# Altium schematic sheet transmitter.SchDoc
size A1
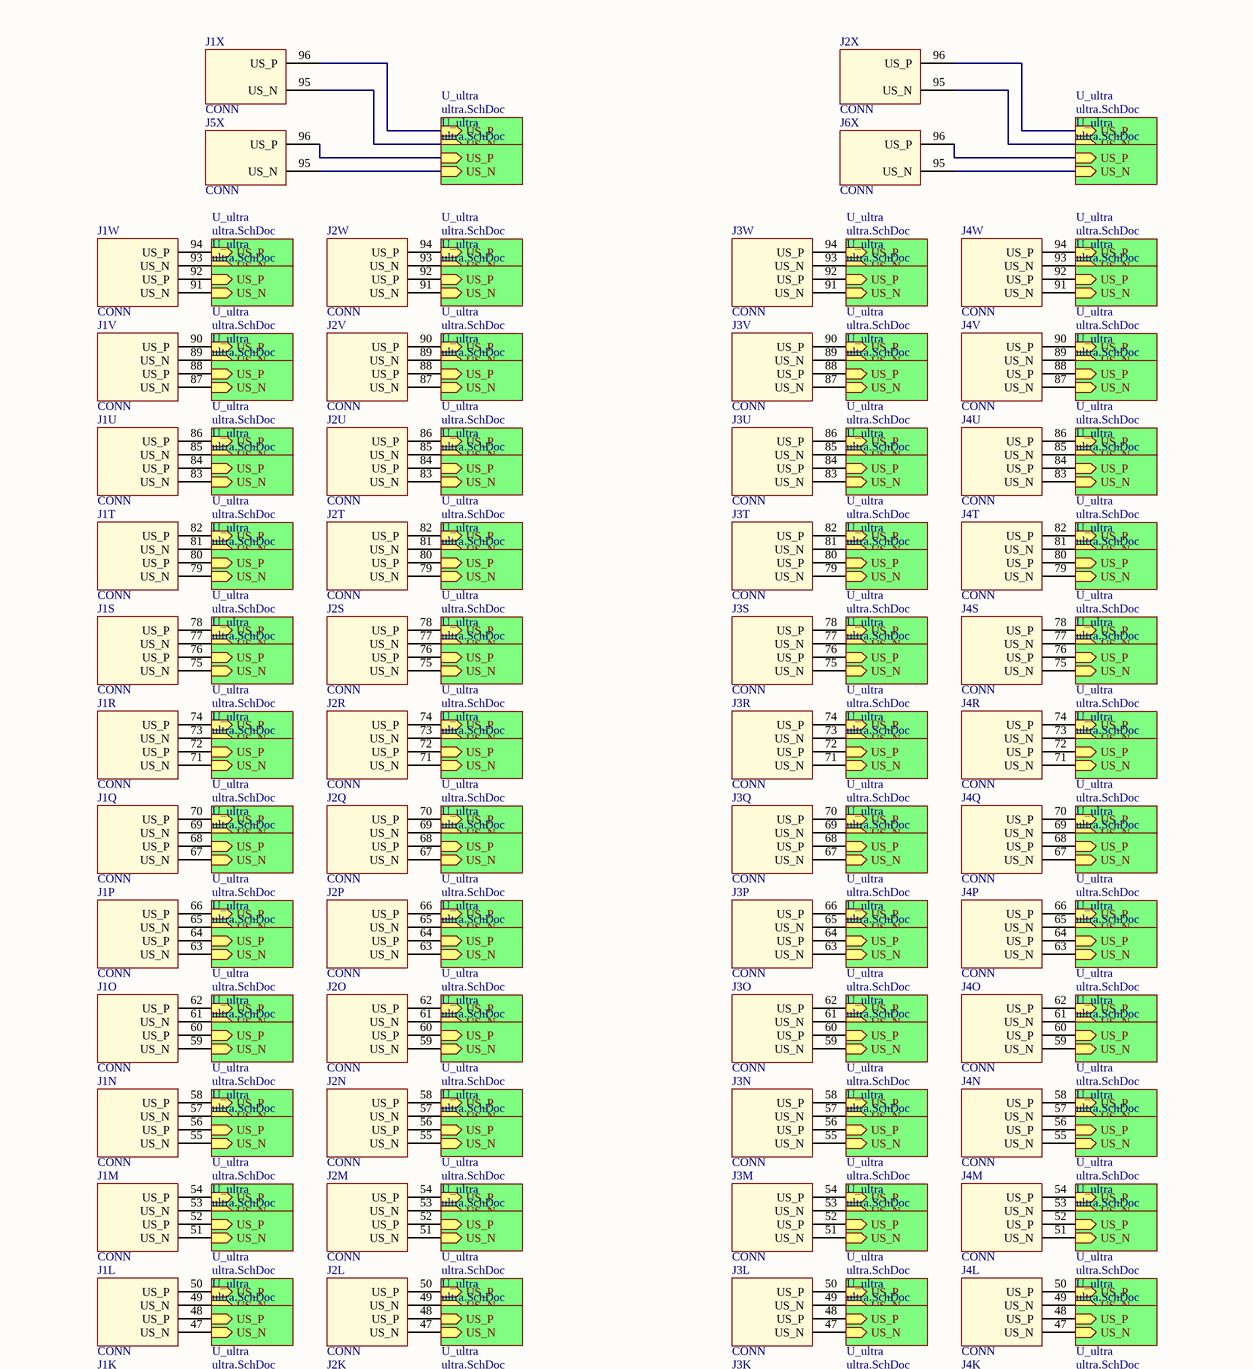
[diagram p0: transmitter.SchDoc, top left]
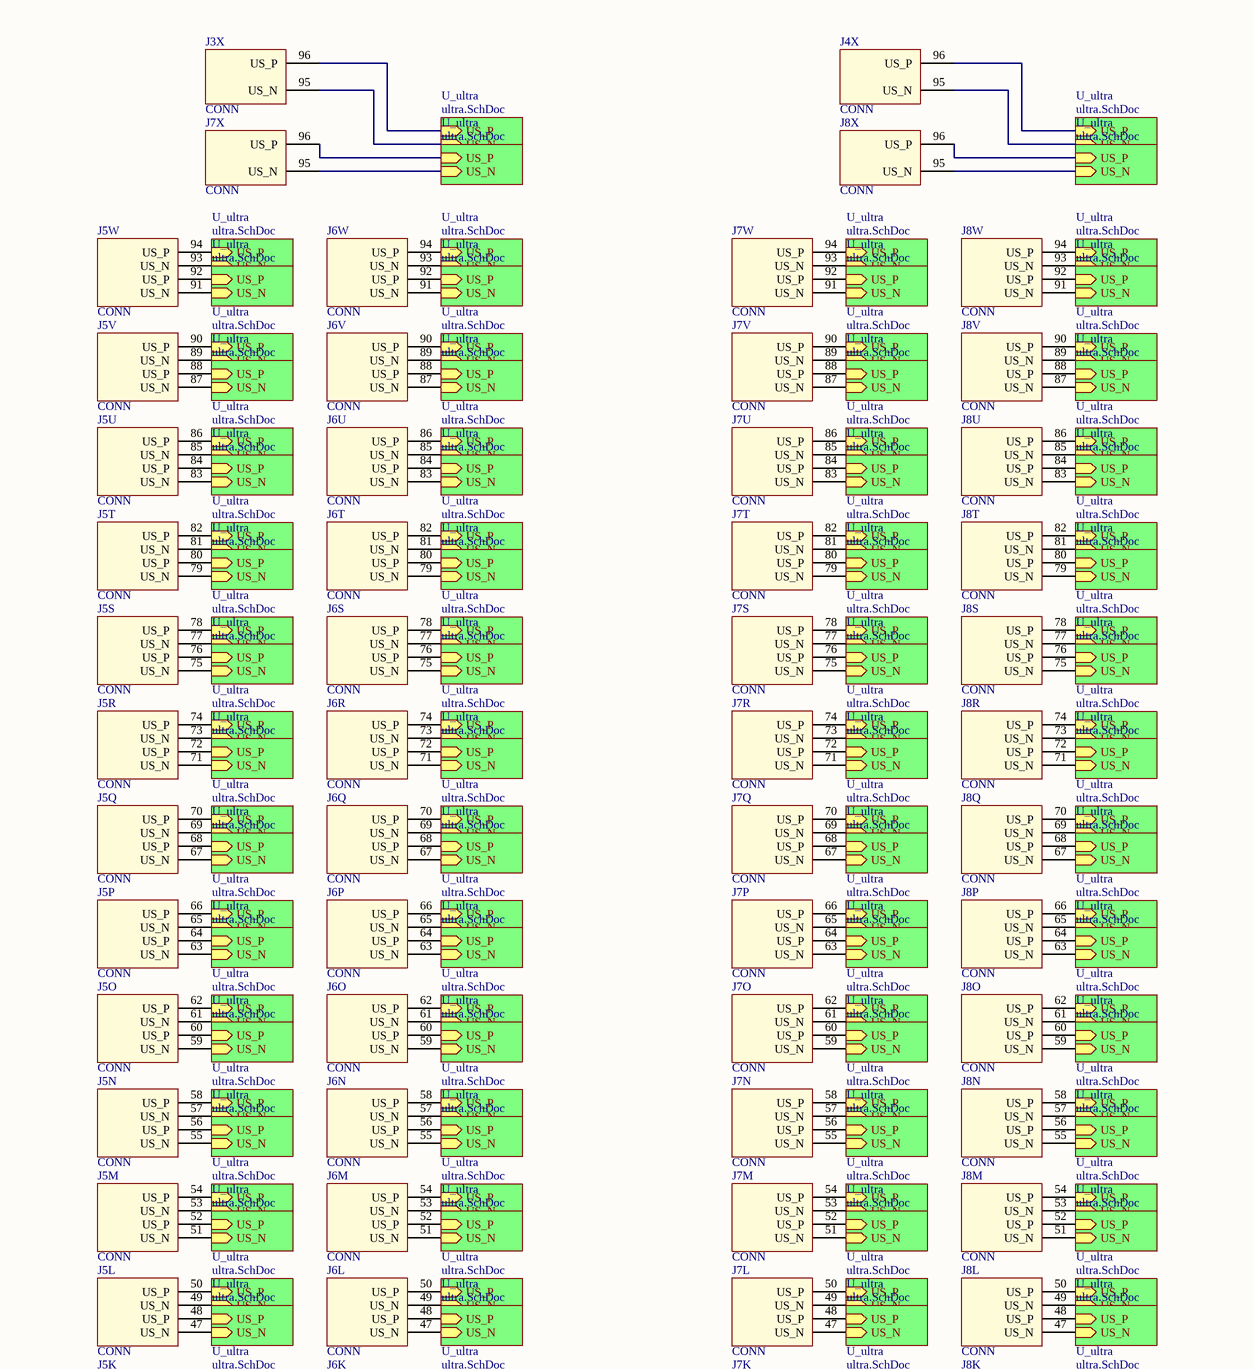
[diagram p1: transmitter.SchDoc, top right]
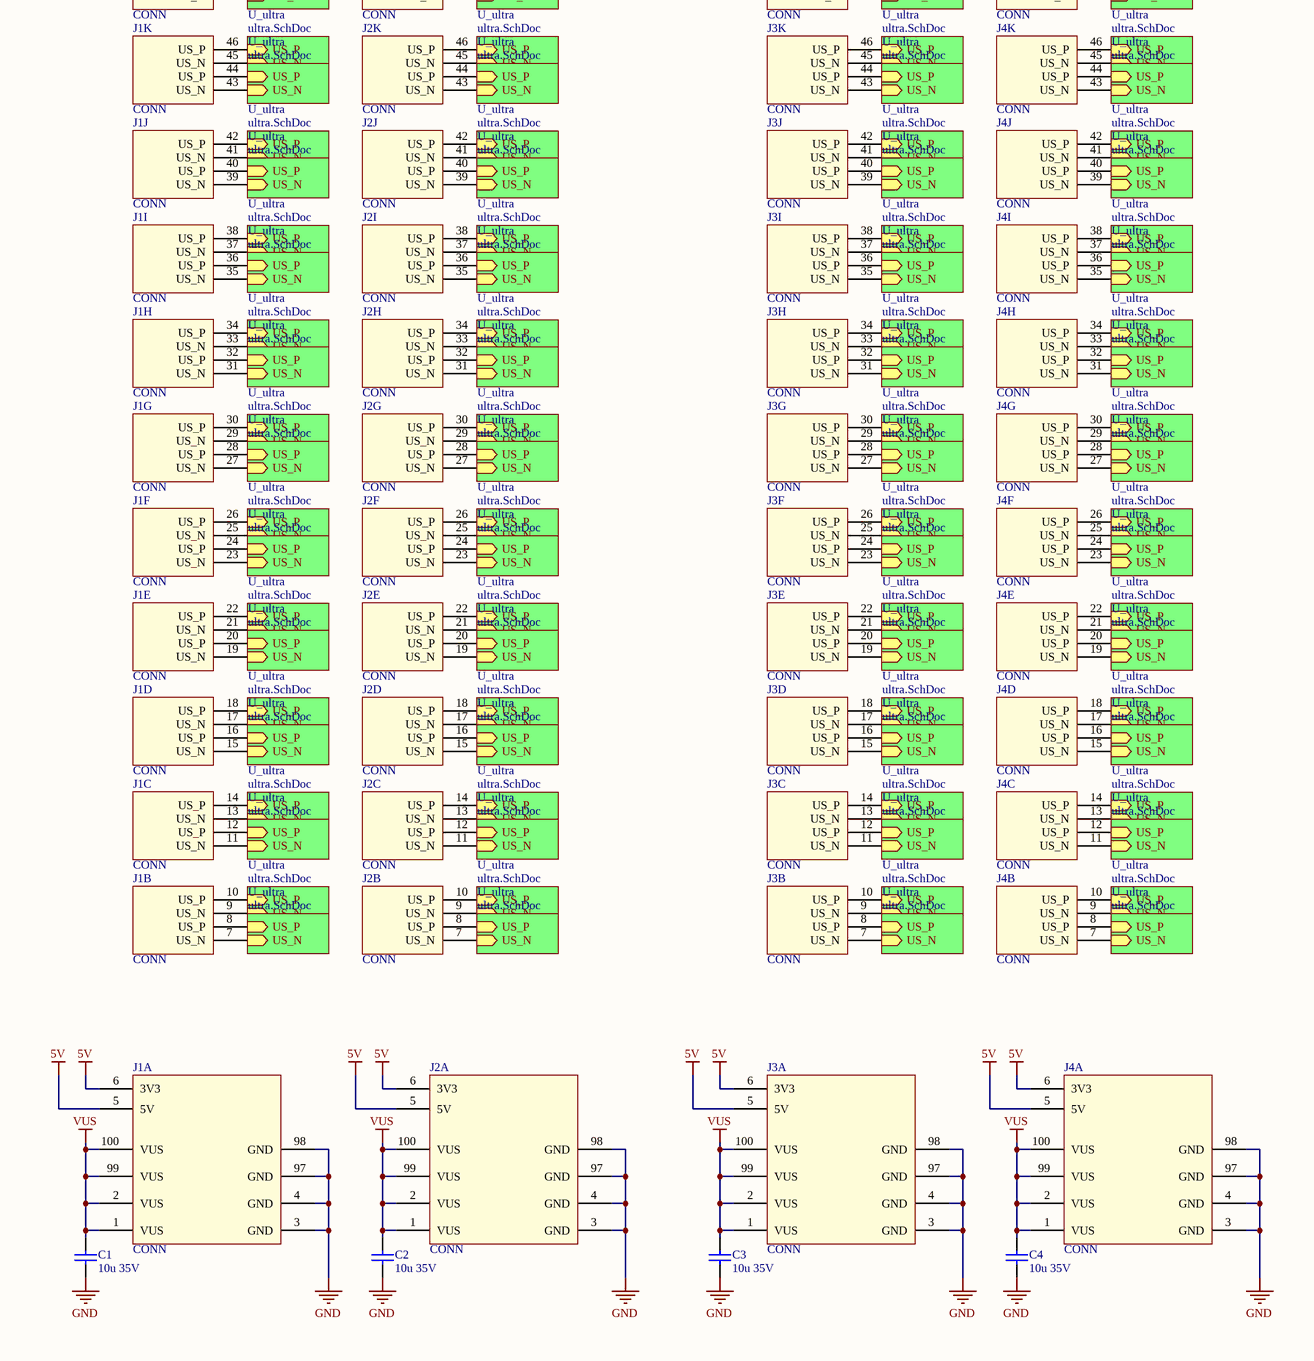
[diagram p2: transmitter.SchDoc, bottom left]
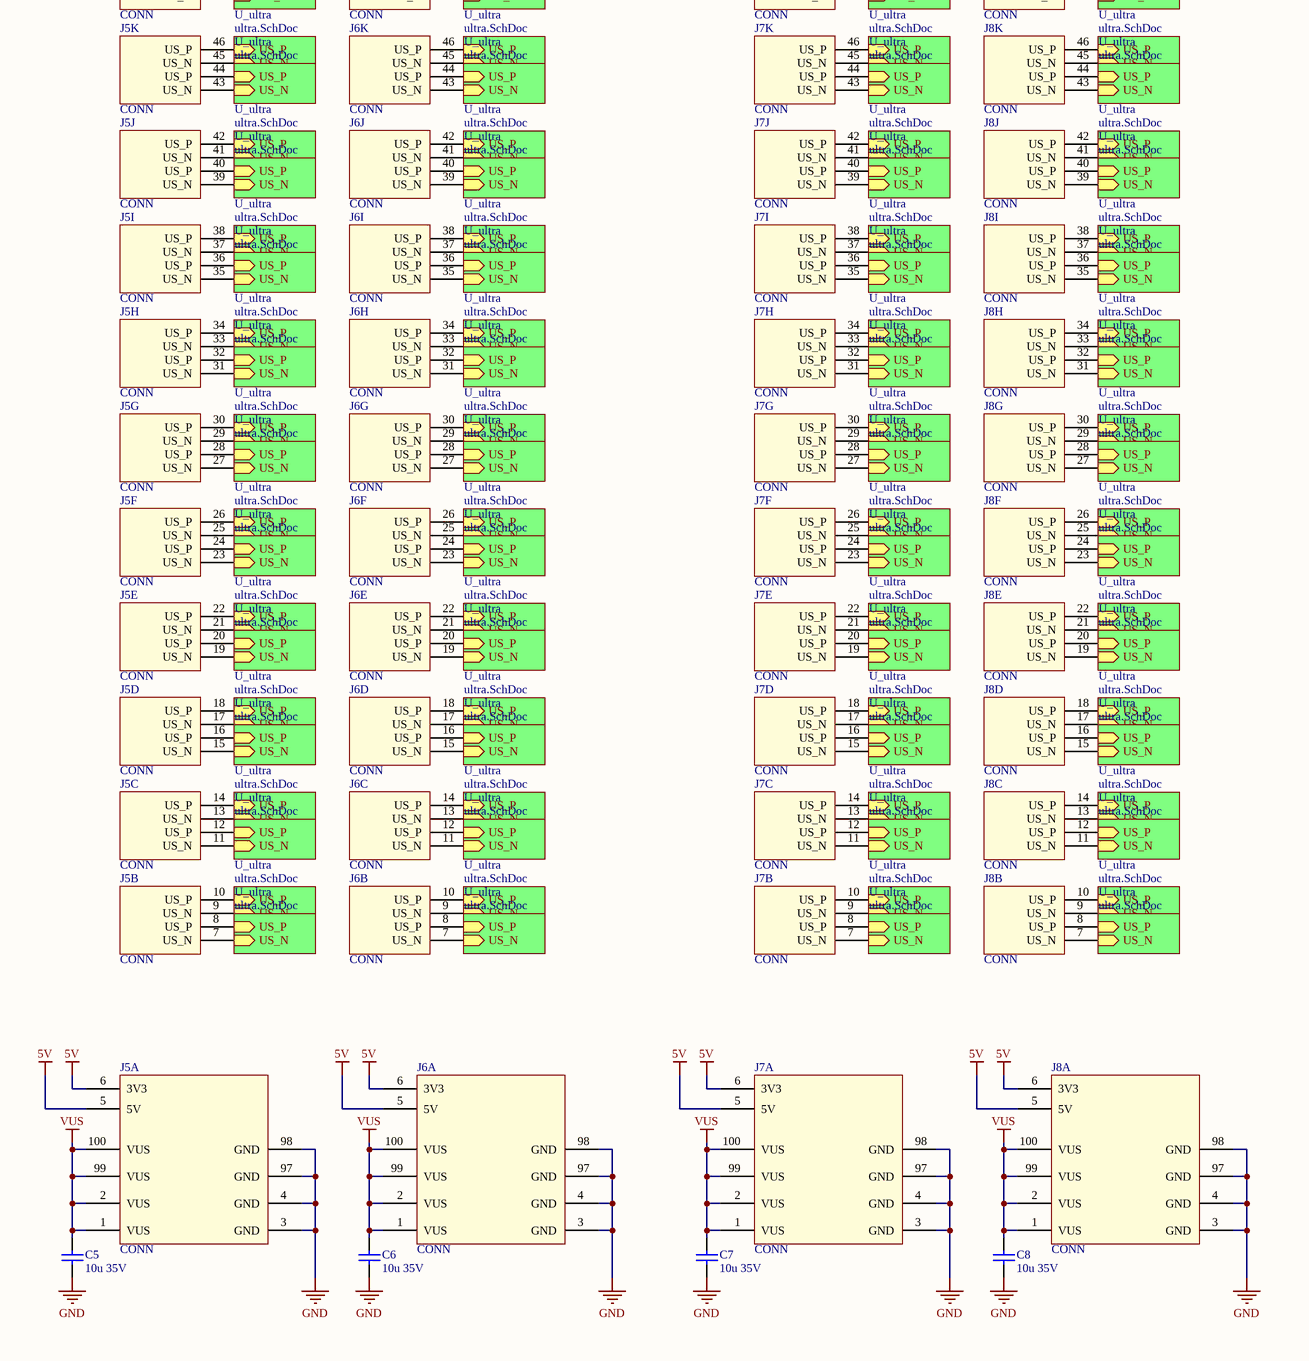
[diagram p3: transmitter.SchDoc, bottom right]

## Parts
C1  10u 35V  [C-0805-M]
C2  10u 35V  [C-0805-M]
C3  10u 35V  [C-0805-M]
C4  10u 35V  [C-0805-M]
C5  10u 35V  [C-0805-M]
C6  10u 35V  [C-0805-M]
C7  10u 35V  [C-0805-M]
C8  10u 35V  [C-0805-M]
J1  CONN  [SOP127P640X300-100L]  (parts A,B,C,D,E,F,G,H,I,J,K,L,M,N,O,P,Q,R,S,T,U,V,W,X of 24)
J2  CONN  [SOP127P640X300-100L]  (parts A,B,C,D,E,F,G,H,I,J,K,L,M,N,O,P,Q,R,S,T,U,V,W,X of 24)
J3  CONN  [SOP127P640X300-100L]  (parts A,B,C,D,E,F,G,H,I,J,K,L,M,N,O,P,Q,R,S,T,U,V,W,X of 24)
J4  CONN  [SOP127P640X300-100L]  (parts A,B,C,D,E,F,G,H,I,J,K,L,M,N,O,P,Q,R,S,T,U,V,W,X of 24)
J5  CONN  [SOP127P640X300-100L]  (parts A,B,C,D,E,F,G,H,I,J,K,L,M,N,O,P,Q,R,S,T,U,V,W,X of 24)
J6  CONN  [SOP127P640X300-100L]  (parts A,B,C,D,E,F,G,H,I,J,K,L,M,N,O,P,Q,R,S,T,U,V,W,X of 24)
J7  CONN  [SOP127P640X300-100L]  (parts A,B,C,D,E,F,G,H,I,J,K,L,M,N,O,P,Q,R,S,T,U,V,W,X of 24)
J8  CONN  [SOP127P640X300-100L]  (parts A,B,C,D,E,F,G,H,I,J,K,L,M,N,O,P,Q,R,S,T,U,V,W,X of 24)

## Sub-sheets
U_ultra = ultra.SchDoc: US_P (in), US_N (in)
U_ultra = ultra.SchDoc: US_P (in), US_N (in)
U_ultra = ultra.SchDoc: US_P (in), US_N (in)
U_ultra = ultra.SchDoc: US_P (in), US_N (in)
U_ultra = ultra.SchDoc: US_P (in), US_N (in)
U_ultra = ultra.SchDoc: US_P (in), US_N (in)
U_ultra = ultra.SchDoc: US_P (in), US_N (in)
U_ultra = ultra.SchDoc: US_P (in), US_N (in)
U_ultra = ultra.SchDoc: US_P (in), US_N (in)
U_ultra = ultra.SchDoc: US_P (in), US_N (in)
U_ultra = ultra.SchDoc: US_P (in), US_N (in)
U_ultra = ultra.SchDoc: US_P (in), US_N (in)
U_ultra = ultra.SchDoc: US_P (in), US_N (in)
U_ultra = ultra.SchDoc: US_P (in), US_N (in)
U_ultra = ultra.SchDoc: US_P (in), US_N (in)
U_ultra = ultra.SchDoc: US_P (in), US_N (in)
U_ultra = ultra.SchDoc: US_P (in), US_N (in)
U_ultra = ultra.SchDoc: US_P (in), US_N (in)
U_ultra = ultra.SchDoc: US_P (in), US_N (in)
U_ultra = ultra.SchDoc: US_P (in), US_N (in)
U_ultra = ultra.SchDoc: US_P (in), US_N (in)
U_ultra = ultra.SchDoc: US_P (in), US_N (in)
U_ultra = ultra.SchDoc: US_P (in), US_N (in)
U_ultra = ultra.SchDoc: US_P (in), US_N (in)
U_ultra = ultra.SchDoc: US_P (in), US_N (in)
U_ultra = ultra.SchDoc: US_P (in), US_N (in)
U_ultra = ultra.SchDoc: US_P (in), US_N (in)
U_ultra = ultra.SchDoc: US_P (in), US_N (in)
U_ultra = ultra.SchDoc: US_P (in), US_N (in)
U_ultra = ultra.SchDoc: US_P (in), US_N (in)
U_ultra = ultra.SchDoc: US_P (in), US_N (in)
U_ultra = ultra.SchDoc: US_P (in), US_N (in)
U_ultra = ultra.SchDoc: US_P (in), US_N (in)
U_ultra = ultra.SchDoc: US_P (in), US_N (in)
U_ultra = ultra.SchDoc: US_P (in), US_N (in)
U_ultra = ultra.SchDoc: US_P (in), US_N (in)
U_ultra = ultra.SchDoc: US_P (in), US_N (in)
U_ultra = ultra.SchDoc: US_P (in), US_N (in)
U_ultra = ultra.SchDoc: US_P (in), US_N (in)
U_ultra = ultra.SchDoc: US_P (in), US_N (in)
U_ultra = ultra.SchDoc: US_P (in), US_N (in)
U_ultra = ultra.SchDoc: US_P (in), US_N (in)
U_ultra = ultra.SchDoc: US_P (in), US_N (in)
U_ultra = ultra.SchDoc: US_P (in), US_N (in)
U_ultra = ultra.SchDoc: US_P (in), US_N (in)
U_ultra = ultra.SchDoc: US_P (in), US_N (in)
U_ultra = ultra.SchDoc: US_P (in), US_N (in)
U_ultra = ultra.SchDoc: US_P (in), US_N (in)
U_ultra = ultra.SchDoc: US_P (in), US_N (in)
U_ultra = ultra.SchDoc: US_P (in), US_N (in)
U_ultra = ultra.SchDoc: US_P (in), US_N (in)
U_ultra = ultra.SchDoc: US_P (in), US_N (in)
U_ultra = ultra.SchDoc: US_P (in), US_N (in)
U_ultra = ultra.SchDoc: US_P (in), US_N (in)
U_ultra = ultra.SchDoc: US_P (in), US_N (in)
U_ultra = ultra.SchDoc: US_P (in), US_N (in)
U_ultra = ultra.SchDoc: US_P (in), US_N (in)
U_ultra = ultra.SchDoc: US_P (in), US_N (in)
U_ultra = ultra.SchDoc: US_P (in), US_N (in)
U_ultra = ultra.SchDoc: US_P (in), US_N (in)
U_ultra = ultra.SchDoc: US_P (in), US_N (in)
U_ultra = ultra.SchDoc: US_P (in), US_N (in)
U_ultra = ultra.SchDoc: US_P (in), US_N (in)
U_ultra = ultra.SchDoc: US_P (in), US_N (in)
U_ultra = ultra.SchDoc: US_P (in), US_N (in)
U_ultra = ultra.SchDoc: US_P (in), US_N (in)
U_ultra = ultra.SchDoc: US_P (in), US_N (in)
U_ultra = ultra.SchDoc: US_P (in), US_N (in)
U_ultra = ultra.SchDoc: US_P (in), US_N (in)
U_ultra = ultra.SchDoc: US_P (in), US_N (in)
U_ultra = ultra.SchDoc: US_P (in), US_N (in)
U_ultra = ultra.SchDoc: US_P (in), US_N (in)
U_ultra = ultra.SchDoc: US_P (in), US_N (in)
U_ultra = ultra.SchDoc: US_P (in), US_N (in)
U_ultra = ultra.SchDoc: US_P (in), US_N (in)
U_ultra = ultra.SchDoc: US_P (in), US_N (in)
U_ultra = ultra.SchDoc: US_P (in), US_N (in)
U_ultra = ultra.SchDoc: US_P (in), US_N (in)
U_ultra = ultra.SchDoc: US_P (in), US_N (in)
U_ultra = ultra.SchDoc: US_P (in), US_N (in)
U_ultra = ultra.SchDoc: US_P (in), US_N (in)
U_ultra = ultra.SchDoc: US_P (in), US_N (in)
U_ultra = ultra.SchDoc: US_P (in), US_N (in)
U_ultra = ultra.SchDoc: US_P (in), US_N (in)
U_ultra = ultra.SchDoc: US_P (in), US_N (in)
U_ultra = ultra.SchDoc: US_P (in), US_N (in)
U_ultra = ultra.SchDoc: US_P (in), US_N (in)
U_ultra = ultra.SchDoc: US_P (in), US_N (in)
U_ultra = ultra.SchDoc: US_P (in), US_N (in)
U_ultra = ultra.SchDoc: US_P (in), US_N (in)
U_ultra = ultra.SchDoc: US_P (in), US_N (in)
U_ultra = ultra.SchDoc: US_P (in), US_N (in)
U_ultra = ultra.SchDoc: US_P (in), US_N (in)
U_ultra = ultra.SchDoc: US_P (in), US_N (in)
U_ultra = ultra.SchDoc: US_P (in), US_N (in)
U_ultra = ultra.SchDoc: US_P (in), US_N (in)
U_ultra = ultra.SchDoc: US_P (in), US_N (in)
U_ultra = ultra.SchDoc: US_P (in), US_N (in)
U_ultra = ultra.SchDoc: US_P (in), US_N (in)
U_ultra = ultra.SchDoc: US_P (in), US_N (in)
U_ultra = ultra.SchDoc: US_P (in), US_N (in)
U_ultra = ultra.SchDoc: US_P (in), US_N (in)
U_ultra = ultra.SchDoc: US_P (in), US_N (in)
U_ultra = ultra.SchDoc: US_P (in), US_N (in)
U_ultra = ultra.SchDoc: US_P (in), US_N (in)
U_ultra = ultra.SchDoc: US_P (in), US_N (in)
U_ultra = ultra.SchDoc: US_P (in), US_N (in)
U_ultra = ultra.SchDoc: US_P (in), US_N (in)
U_ultra = ultra.SchDoc: US_P (in), US_N (in)
U_ultra = ultra.SchDoc: US_P (in), US_N (in)
U_ultra = ultra.SchDoc: US_P (in), US_N (in)
U_ultra = ultra.SchDoc: US_P (in), US_N (in)
U_ultra = ultra.SchDoc: US_P (in), US_N (in)
U_ultra = ultra.SchDoc: US_P (in), US_N (in)
U_ultra = ultra.SchDoc: US_P (in), US_N (in)
U_ultra = ultra.SchDoc: US_P (in), US_N (in)
U_ultra = ultra.SchDoc: US_P (in), US_N (in)
U_ultra = ultra.SchDoc: US_P (in), US_N (in)
U_ultra = ultra.SchDoc: US_P (in), US_N (in)
U_ultra = ultra.SchDoc: US_P (in), US_N (in)
U_ultra = ultra.SchDoc: US_P (in), US_N (in)
U_ultra = ultra.SchDoc: US_P (in), US_N (in)
U_ultra = ultra.SchDoc: US_P (in), US_N (in)
U_ultra = ultra.SchDoc: US_P (in), US_N (in)
U_ultra = ultra.SchDoc: US_P (in), US_N (in)
U_ultra = ultra.SchDoc: US_P (in), US_N (in)
U_ultra = ultra.SchDoc: US_P (in), US_N (in)
U_ultra = ultra.SchDoc: US_P (in), US_N (in)
U_ultra = ultra.SchDoc: US_P (in), US_N (in)
U_ultra = ultra.SchDoc: US_P (in), US_N (in)
U_ultra = ultra.SchDoc: US_P (in), US_N (in)
U_ultra = ultra.SchDoc: US_P (in), US_N (in)
U_ultra = ultra.SchDoc: US_P (in), US_N (in)
U_ultra = ultra.SchDoc: US_P (in), US_N (in)
U_ultra = ultra.SchDoc: US_P (in), US_N (in)
U_ultra = ultra.SchDoc: US_P (in), US_N (in)
U_ultra = ultra.SchDoc: US_P (in), US_N (in)
U_ultra = ultra.SchDoc: US_P (in), US_N (in)
U_ultra = ultra.SchDoc: US_P (in), US_N (in)
U_ultra = ultra.SchDoc: US_P (in), US_N (in)
U_ultra = ultra.SchDoc: US_P (in), US_N (in)
U_ultra = ultra.SchDoc: US_P (in), US_N (in)
U_ultra = ultra.SchDoc: US_P (in), US_N (in)
U_ultra = ultra.SchDoc: US_P (in), US_N (in)
U_ultra = ultra.SchDoc: US_P (in), US_N (in)
U_ultra = ultra.SchDoc: US_P (in), US_N (in)
U_ultra = ultra.SchDoc: US_P (in), US_N (in)
U_ultra = ultra.SchDoc: US_P (in), US_N (in)
U_ultra = ultra.SchDoc: US_P (in), US_N (in)
U_ultra = ultra.SchDoc: US_P (in), US_N (in)
U_ultra = ultra.SchDoc: US_P (in), US_N (in)
U_ultra = ultra.SchDoc: US_P (in), US_N (in)
U_ultra = ultra.SchDoc: US_P (in), US_N (in)
U_ultra = ultra.SchDoc: US_P (in), US_N (in)
U_ultra = ultra.SchDoc: US_P (in), US_N (in)
U_ultra = ultra.SchDoc: US_P (in), US_N (in)
U_ultra = ultra.SchDoc: US_P (in), US_N (in)
U_ultra = ultra.SchDoc: US_P (in), US_N (in)
U_ultra = ultra.SchDoc: US_P (in), US_N (in)
U_ultra = ultra.SchDoc: US_P (in), US_N (in)
U_ultra = ultra.SchDoc: US_P (in), US_N (in)
U_ultra = ultra.SchDoc: US_P (in), US_N (in)
U_ultra = ultra.SchDoc: US_P (in), US_N (in)
U_ultra = ultra.SchDoc: US_P (in), US_N (in)
U_ultra = ultra.SchDoc: US_P (in), US_N (in)
U_ultra = ultra.SchDoc: US_P (in), US_N (in)
U_ultra = ultra.SchDoc: US_P (in), US_N (in)
U_ultra = ultra.SchDoc: US_P (in), US_N (in)
U_ultra = ultra.SchDoc: US_P (in), US_N (in)
U_ultra = ultra.SchDoc: US_P (in), US_N (in)
U_ultra = ultra.SchDoc: US_P (in), US_N (in)
U_ultra = ultra.SchDoc: US_P (in), US_N (in)
U_ultra = ultra.SchDoc: US_P (in), US_N (in)
U_ultra = ultra.SchDoc: US_P (in), US_N (in)
U_ultra = ultra.SchDoc: US_P (in), US_N (in)
U_ultra = ultra.SchDoc: US_P (in), US_N (in)
U_ultra = ultra.SchDoc: US_P (in), US_N (in)
U_ultra = ultra.SchDoc: US_P (in), US_N (in)
U_ultra = ultra.SchDoc: US_P (in), US_N (in)
U_ultra = ultra.SchDoc: US_P (in), US_N (in)
U_ultra = ultra.SchDoc: US_P (in), US_N (in)
U_ultra = ultra.SchDoc: US_P (in), US_N (in)
U_ultra = ultra.SchDoc: US_P (in), US_N (in)
U_ultra = ultra.SchDoc: US_P (in), US_N (in)
U_ultra = ultra.SchDoc: US_P (in), US_N (in)
U_ultra = ultra.SchDoc: US_P (in), US_N (in)
U_ultra = ultra.SchDoc: US_P (in), US_N (in)
U_ultra = ultra.SchDoc: US_P (in), US_N (in)
U_ultra = ultra.SchDoc: US_P (in), US_N (in)
U_ultra = ultra.SchDoc: US_P (in), US_N (in)
U_ultra = ultra.SchDoc: US_P (in), US_N (in)
U_ultra = ultra.SchDoc: US_P (in), US_N (in)
U_ultra = ultra.SchDoc: US_P (in), US_N (in)
U_ultra = ultra.SchDoc: US_P (in), US_N (in)
U_ultra = ultra.SchDoc: US_P (in), US_N (in)
U_ultra = ultra.SchDoc: US_P (in), US_N (in)
U_ultra = ultra.SchDoc: US_P (in), US_N (in)
U_ultra = ultra.SchDoc: US_P (in), US_N (in)
U_ultra = ultra.SchDoc: US_P (in), US_N (in)
U_ultra = ultra.SchDoc: US_P (in), US_N (in)
U_ultra = ultra.SchDoc: US_P (in), US_N (in)
U_ultra = ultra.SchDoc: US_P (in), US_N (in)
U_ultra = ultra.SchDoc: US_P (in), US_N (in)
U_ultra = ultra.SchDoc: US_P (in), US_N (in)
U_ultra = ultra.SchDoc: US_P (in), US_N (in)
U_ultra = ultra.SchDoc: US_P (in), US_N (in)
U_ultra = ultra.SchDoc: US_P (in), US_N (in)
U_ultra = ultra.SchDoc: US_P (in), US_N (in)
U_ultra = ultra.SchDoc: US_P (in), US_N (in)
U_ultra = ultra.SchDoc: US_P (in), US_N (in)
U_ultra = ultra.SchDoc: US_P (in), US_N (in)
U_ultra = ultra.SchDoc: US_P (in), US_N (in)
U_ultra = ultra.SchDoc: US_P (in), US_N (in)
U_ultra = ultra.SchDoc: US_P (in), US_N (in)
U_ultra = ultra.SchDoc: US_P (in), US_N (in)
U_ultra = ultra.SchDoc: US_P (in), US_N (in)
U_ultra = ultra.SchDoc: US_P (in), US_N (in)
U_ultra = ultra.SchDoc: US_P (in), US_N (in)
U_ultra = ultra.SchDoc: US_P (in), US_N (in)
U_ultra = ultra.SchDoc: US_P (in), US_N (in)
U_ultra = ultra.SchDoc: US_P (in), US_N (in)
U_ultra = ultra.SchDoc: US_P (in), US_N (in)
U_ultra = ultra.SchDoc: US_P (in), US_N (in)
U_ultra = ultra.SchDoc: US_P (in), US_N (in)
U_ultra = ultra.SchDoc: US_P (in), US_N (in)
U_ultra = ultra.SchDoc: US_P (in), US_N (in)
U_ultra = ultra.SchDoc: US_P (in), US_N (in)
U_ultra = ultra.SchDoc: US_P (in), US_N (in)
U_ultra = ultra.SchDoc: US_P (in), US_N (in)
U_ultra = ultra.SchDoc: US_P (in), US_N (in)
U_ultra = ultra.SchDoc: US_P (in), US_N (in)
U_ultra = ultra.SchDoc: US_P (in), US_N (in)
U_ultra = ultra.SchDoc: US_P (in), US_N (in)
U_ultra = ultra.SchDoc: US_P (in), US_N (in)
U_ultra = ultra.SchDoc: US_P (in), US_N (in)
U_ultra = ultra.SchDoc: US_P (in), US_N (in)
U_ultra = ultra.SchDoc: US_P (in), US_N (in)
U_ultra = ultra.SchDoc: US_P (in), US_N (in)
U_ultra = ultra.SchDoc: US_P (in), US_N (in)
U_ultra = ultra.SchDoc: US_P (in), US_N (in)
U_ultra = ultra.SchDoc: US_P (in), US_N (in)
U_ultra = ultra.SchDoc: US_P (in), US_N (in)
U_ultra = ultra.SchDoc: US_P (in), US_N (in)
U_ultra = ultra.SchDoc: US_P (in), US_N (in)
U_ultra = ultra.SchDoc: US_P (in), US_N (in)
U_ultra = ultra.SchDoc: US_P (in), US_N (in)
U_ultra = ultra.SchDoc: US_P (in), US_N (in)
U_ultra = ultra.SchDoc: US_P (in), US_N (in)
U_ultra = ultra.SchDoc: US_P (in), US_N (in)
U_ultra = ultra.SchDoc: US_P (in), US_N (in)
U_ultra = ultra.SchDoc: US_P (in), US_N (in)
U_ultra = ultra.SchDoc: US_P (in), US_N (in)
U_ultra = ultra.SchDoc: US_P (in), US_N (in)
U_ultra = ultra.SchDoc: US_P (in), US_N (in)
U_ultra = ultra.SchDoc: US_P (in), US_N (in)
U_ultra = ultra.SchDoc: US_P (in), US_N (in)
U_ultra = ultra.SchDoc: US_P (in), US_N (in)
U_ultra = ultra.SchDoc: US_P (in), US_N (in)
U_ultra = ultra.SchDoc: US_P (in), US_N (in)
U_ultra = ultra.SchDoc: US_P (in), US_N (in)
U_ultra = ultra.SchDoc: US_P (in), US_N (in)
U_ultra = ultra.SchDoc: US_P (in), US_N (in)
U_ultra = ultra.SchDoc: US_P (in), US_N (in)
U_ultra = ultra.SchDoc: US_P (in), US_N (in)
U_ultra = ultra.SchDoc: US_P (in), US_N (in)
U_ultra = ultra.SchDoc: US_P (in), US_N (in)
U_ultra = ultra.SchDoc: US_P (in), US_N (in)
U_ultra = ultra.SchDoc: US_P (in), US_N (in)
U_ultra = ultra.SchDoc: US_P (in), US_N (in)
U_ultra = ultra.SchDoc: US_P (in), US_N (in)
U_ultra = ultra.SchDoc: US_P (in), US_N (in)
U_ultra = ultra.SchDoc: US_P (in), US_N (in)
U_ultra = ultra.SchDoc: US_P (in), US_N (in)
U_ultra = ultra.SchDoc: US_P (in), US_N (in)
U_ultra = ultra.SchDoc: US_P (in), US_N (in)
U_ultra = ultra.SchDoc: US_P (in), US_N (in)
U_ultra = ultra.SchDoc: US_P (in), US_N (in)
U_ultra = ultra.SchDoc: US_P (in), US_N (in)
U_ultra = ultra.SchDoc: US_P (in), US_N (in)
U_ultra = ultra.SchDoc: US_P (in), US_N (in)
U_ultra = ultra.SchDoc: US_P (in), US_N (in)
U_ultra = ultra.SchDoc: US_P (in), US_N (in)
U_ultra = ultra.SchDoc: US_P (in), US_N (in)
U_ultra = ultra.SchDoc: US_P (in), US_N (in)
U_ultra = ultra.SchDoc: US_P (in), US_N (in)
U_ultra = ultra.SchDoc: US_P (in), US_N (in)
U_ultra = ultra.SchDoc: US_P (in), US_N (in)
U_ultra = ultra.SchDoc: US_P (in), US_N (in)
U_ultra = ultra.SchDoc: US_P (in), US_N (in)
U_ultra = ultra.SchDoc: US_P (in), US_N (in)
U_ultra = ultra.SchDoc: US_P (in), US_N (in)
U_ultra = ultra.SchDoc: US_P (in), US_N (in)
U_ultra = ultra.SchDoc: US_P (in), US_N (in)
U_ultra = ultra.SchDoc: US_P (in), US_N (in)
U_ultra = ultra.SchDoc: US_P (in), US_N (in)
U_ultra = ultra.SchDoc: US_P (in), US_N (in)
U_ultra = ultra.SchDoc: US_P (in), US_N (in)
U_ultra = ultra.SchDoc: US_P (in), US_N (in)
U_ultra = ultra.SchDoc: US_P (in), US_N (in)
U_ultra = ultra.SchDoc: US_P (in), US_N (in)
U_ultra = ultra.SchDoc: US_P (in), US_N (in)
U_ultra = ultra.SchDoc: US_P (in), US_N (in)
U_ultra = ultra.SchDoc: US_P (in), US_N (in)
U_ultra = ultra.SchDoc: US_P (in), US_N (in)
U_ultra = ultra.SchDoc: US_P (in), US_N (in)
U_ultra = ultra.SchDoc: US_P (in), US_N (in)
U_ultra = ultra.SchDoc: US_P (in), US_N (in)
U_ultra = ultra.SchDoc: US_P (in), US_N (in)
U_ultra = ultra.SchDoc: US_P (in), US_N (in)
U_ultra = ultra.SchDoc: US_P (in), US_N (in)
U_ultra = ultra.SchDoc: US_P (in), US_N (in)
U_ultra = ultra.SchDoc: US_P (in), US_N (in)
U_ultra = ultra.SchDoc: US_P (in), US_N (in)
U_ultra = ultra.SchDoc: US_P (in), US_N (in)
U_ultra = ultra.SchDoc: US_P (in), US_N (in)
U_ultra = ultra.SchDoc: US_P (in), US_N (in)
U_ultra = ultra.SchDoc: US_P (in), US_N (in)
U_ultra = ultra.SchDoc: US_P (in), US_N (in)
U_ultra = ultra.SchDoc: US_P (in), US_N (in)
U_ultra = ultra.SchDoc: US_P (in), US_N (in)
U_ultra = ultra.SchDoc: US_P (in), US_N (in)
U_ultra = ultra.SchDoc: US_P (in), US_N (in)
U_ultra = ultra.SchDoc: US_P (in), US_N (in)
U_ultra = ultra.SchDoc: US_P (in), US_N (in)
U_ultra = ultra.SchDoc: US_P (in), US_N (in)
U_ultra = ultra.SchDoc: US_P (in), US_N (in)
U_ultra = ultra.SchDoc: US_P (in), US_N (in)
U_ultra = ultra.SchDoc: US_P (in), US_N (in)
U_ultra = ultra.SchDoc: US_P (in), US_N (in)
U_ultra = ultra.SchDoc: US_P (in), US_N (in)
U_ultra = ultra.SchDoc: US_P (in), US_N (in)
U_ultra = ultra.SchDoc: US_P (in), US_N (in)
U_ultra = ultra.SchDoc: US_P (in), US_N (in)
U_ultra = ultra.SchDoc: US_P (in), US_N (in)
U_ultra = ultra.SchDoc: US_P (in), US_N (in)
U_ultra = ultra.SchDoc: US_P (in), US_N (in)
U_ultra = ultra.SchDoc: US_P (in), US_N (in)
U_ultra = ultra.SchDoc: US_P (in), US_N (in)
U_ultra = ultra.SchDoc: US_P (in), US_N (in)
U_ultra = ultra.SchDoc: US_P (in), US_N (in)
U_ultra = ultra.SchDoc: US_P (in), US_N (in)
U_ultra = ultra.SchDoc: US_P (in), US_N (in)
U_ultra = ultra.SchDoc: US_P (in), US_N (in)
U_ultra = ultra.SchDoc: US_P (in), US_N (in)
U_ultra = ultra.SchDoc: US_P (in), US_N (in)
U_ultra = ultra.SchDoc: US_P (in), US_N (in)
U_ultra = ultra.SchDoc: US_P (in), US_N (in)
U_ultra = ultra.SchDoc: US_P (in), US_N (in)
U_ultra = ultra.SchDoc: US_P (in), US_N (in)
U_ultra = ultra.SchDoc: US_P (in), US_N (in)
U_ultra = ultra.SchDoc: US_P (in), US_N (in)
U_ultra = ultra.SchDoc: US_P (in), US_N (in)
U_ultra = ultra.SchDoc: US_P (in), US_N (in)
U_ultra = ultra.SchDoc: US_P (in), US_N (in)
U_ultra = ultra.SchDoc: US_P (in), US_N (in)
U_ultra = ultra.SchDoc: US_P (in), US_N (in)
U_ultra = ultra.SchDoc: US_P (in), US_N (in)
U_ultra = ultra.SchDoc: US_P (in), US_N (in)
U_ultra = ultra.SchDoc: US_P (in), US_N (in)
U_ultra = ultra.SchDoc: US_P (in), US_N (in)
